# EasyEDA Pro project 智能车.eprj, schematic 主板V2.0

## Sheets
1 P1: Create Date: 2024-03-19; Page Name: P1; Project Name: 智能车; Schematic Name: Schematic4; Update Date: 2024-08-10; Company: 嘉立创EDA; Page Size: A4; Version: V1.0
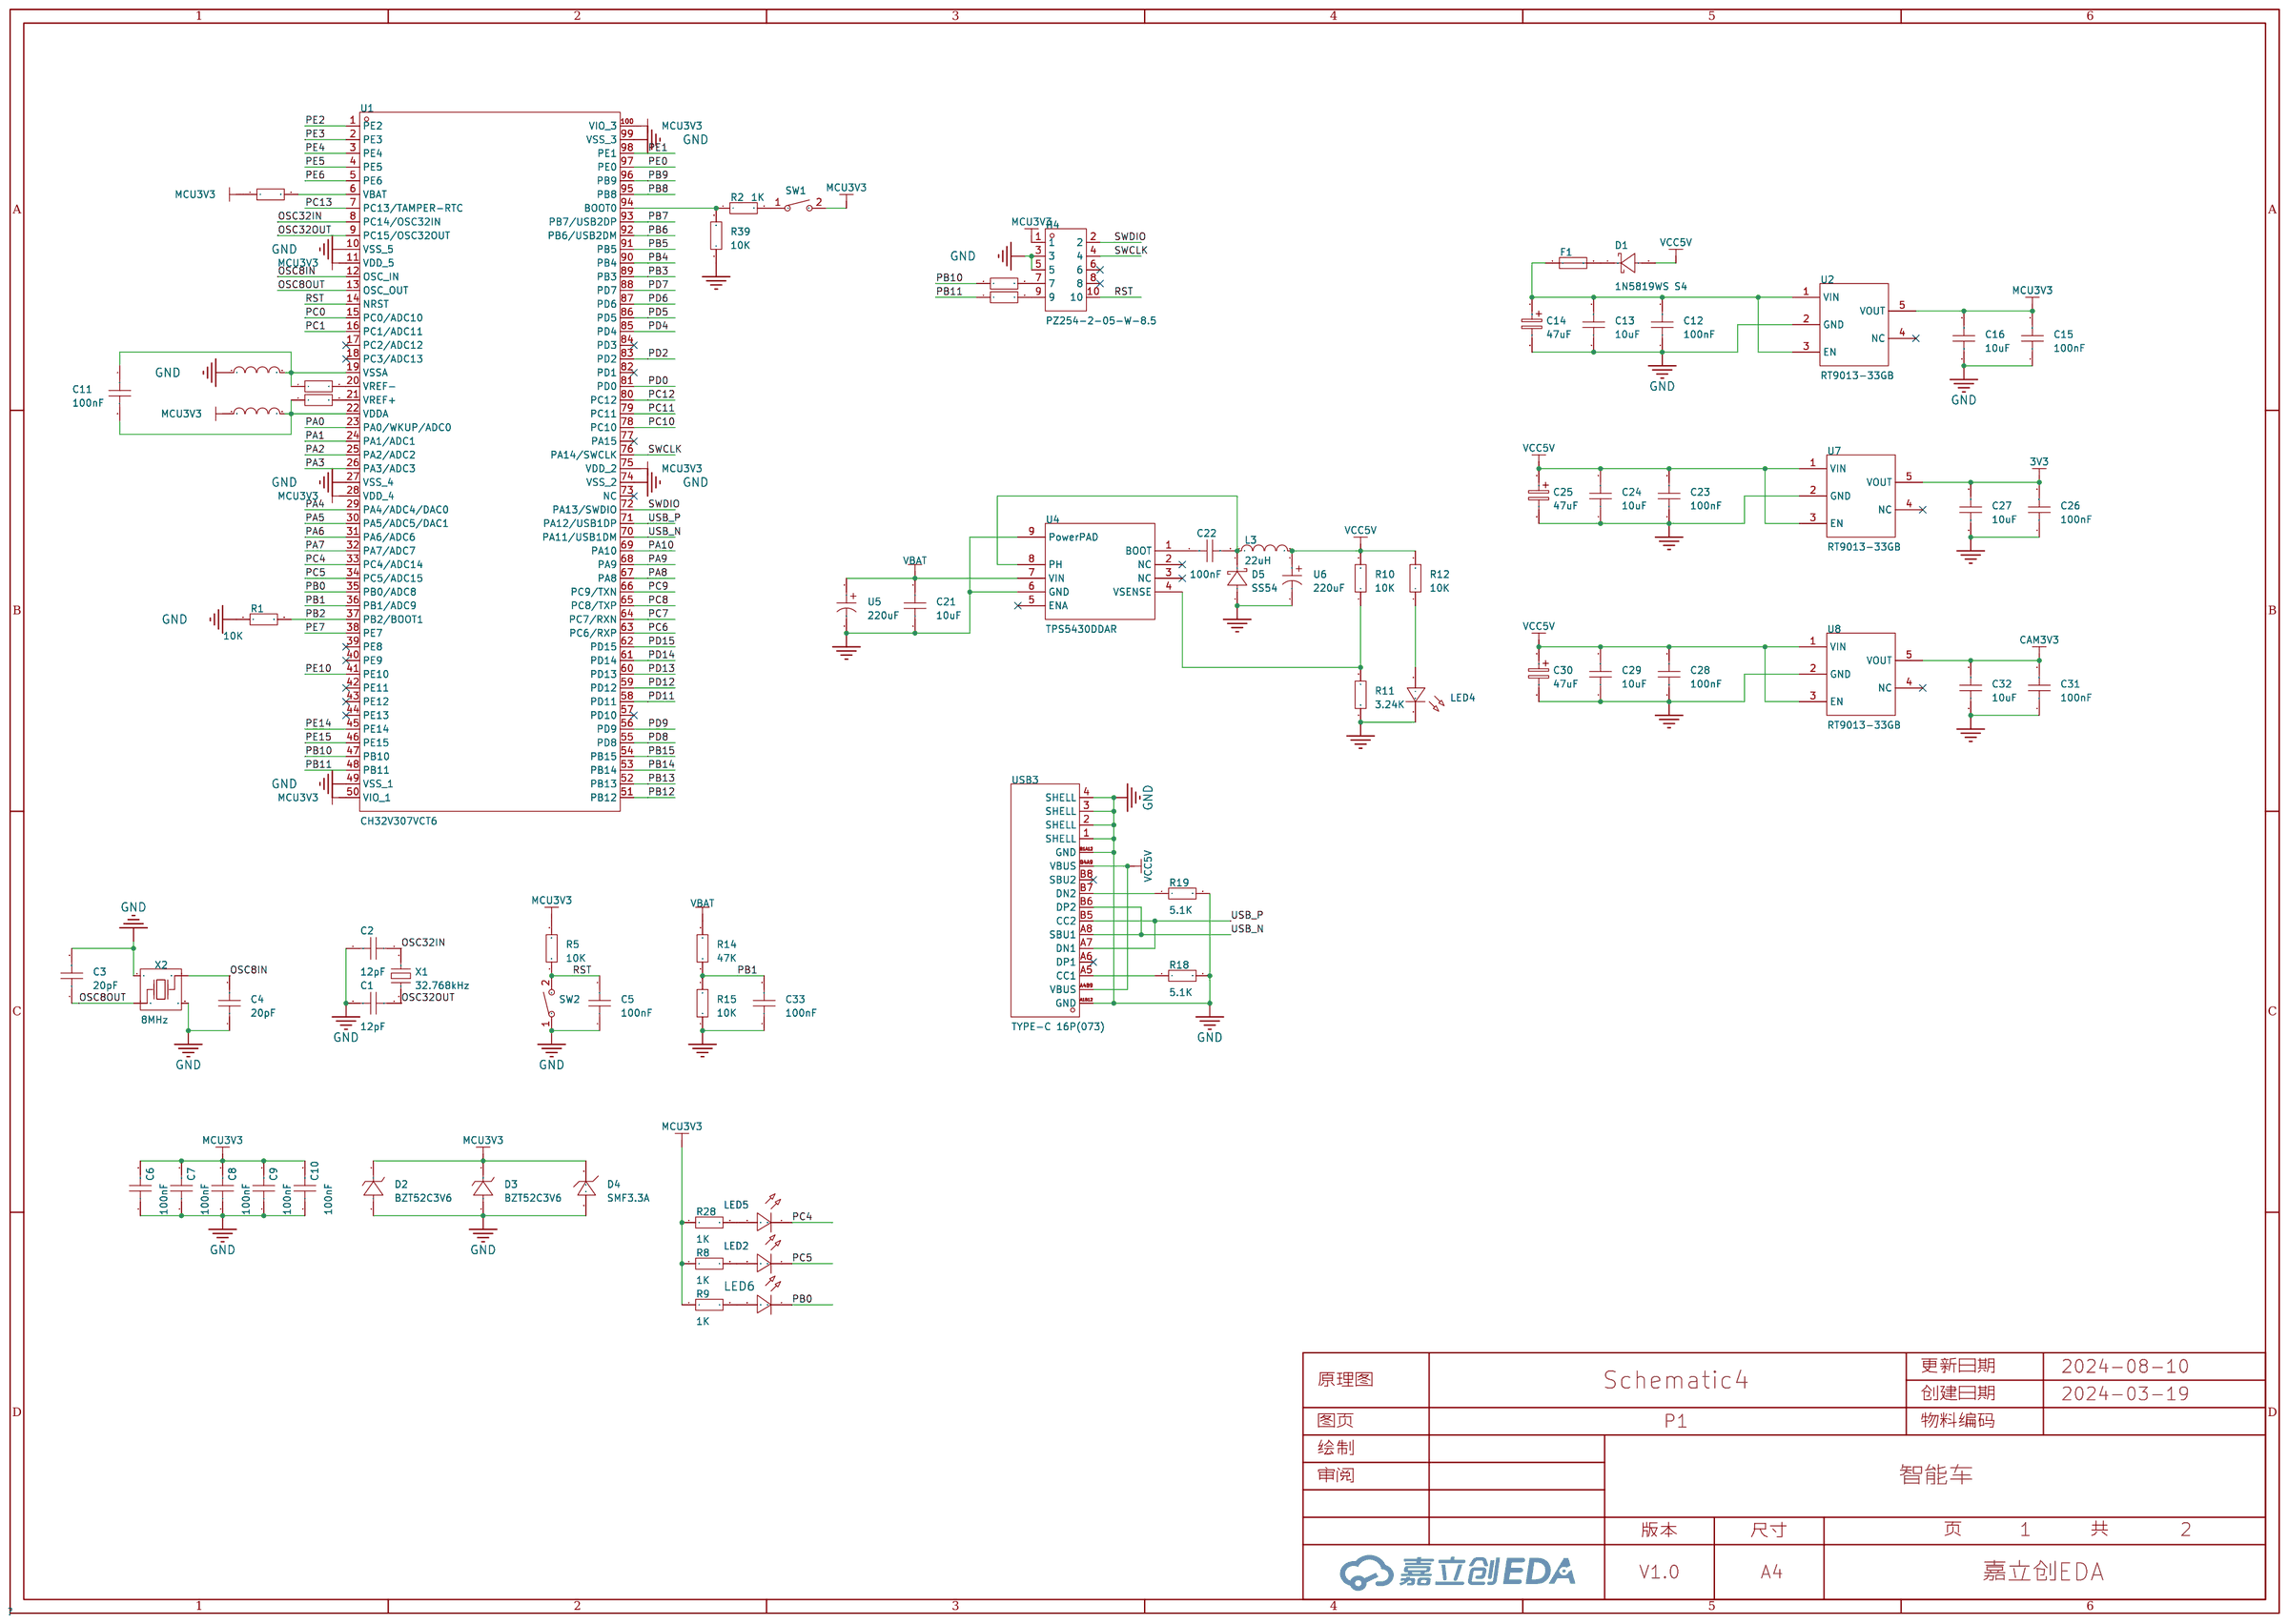
[diagram p8: P1]
2 P2: Page Name: P2; Update Date: 2024-03-29
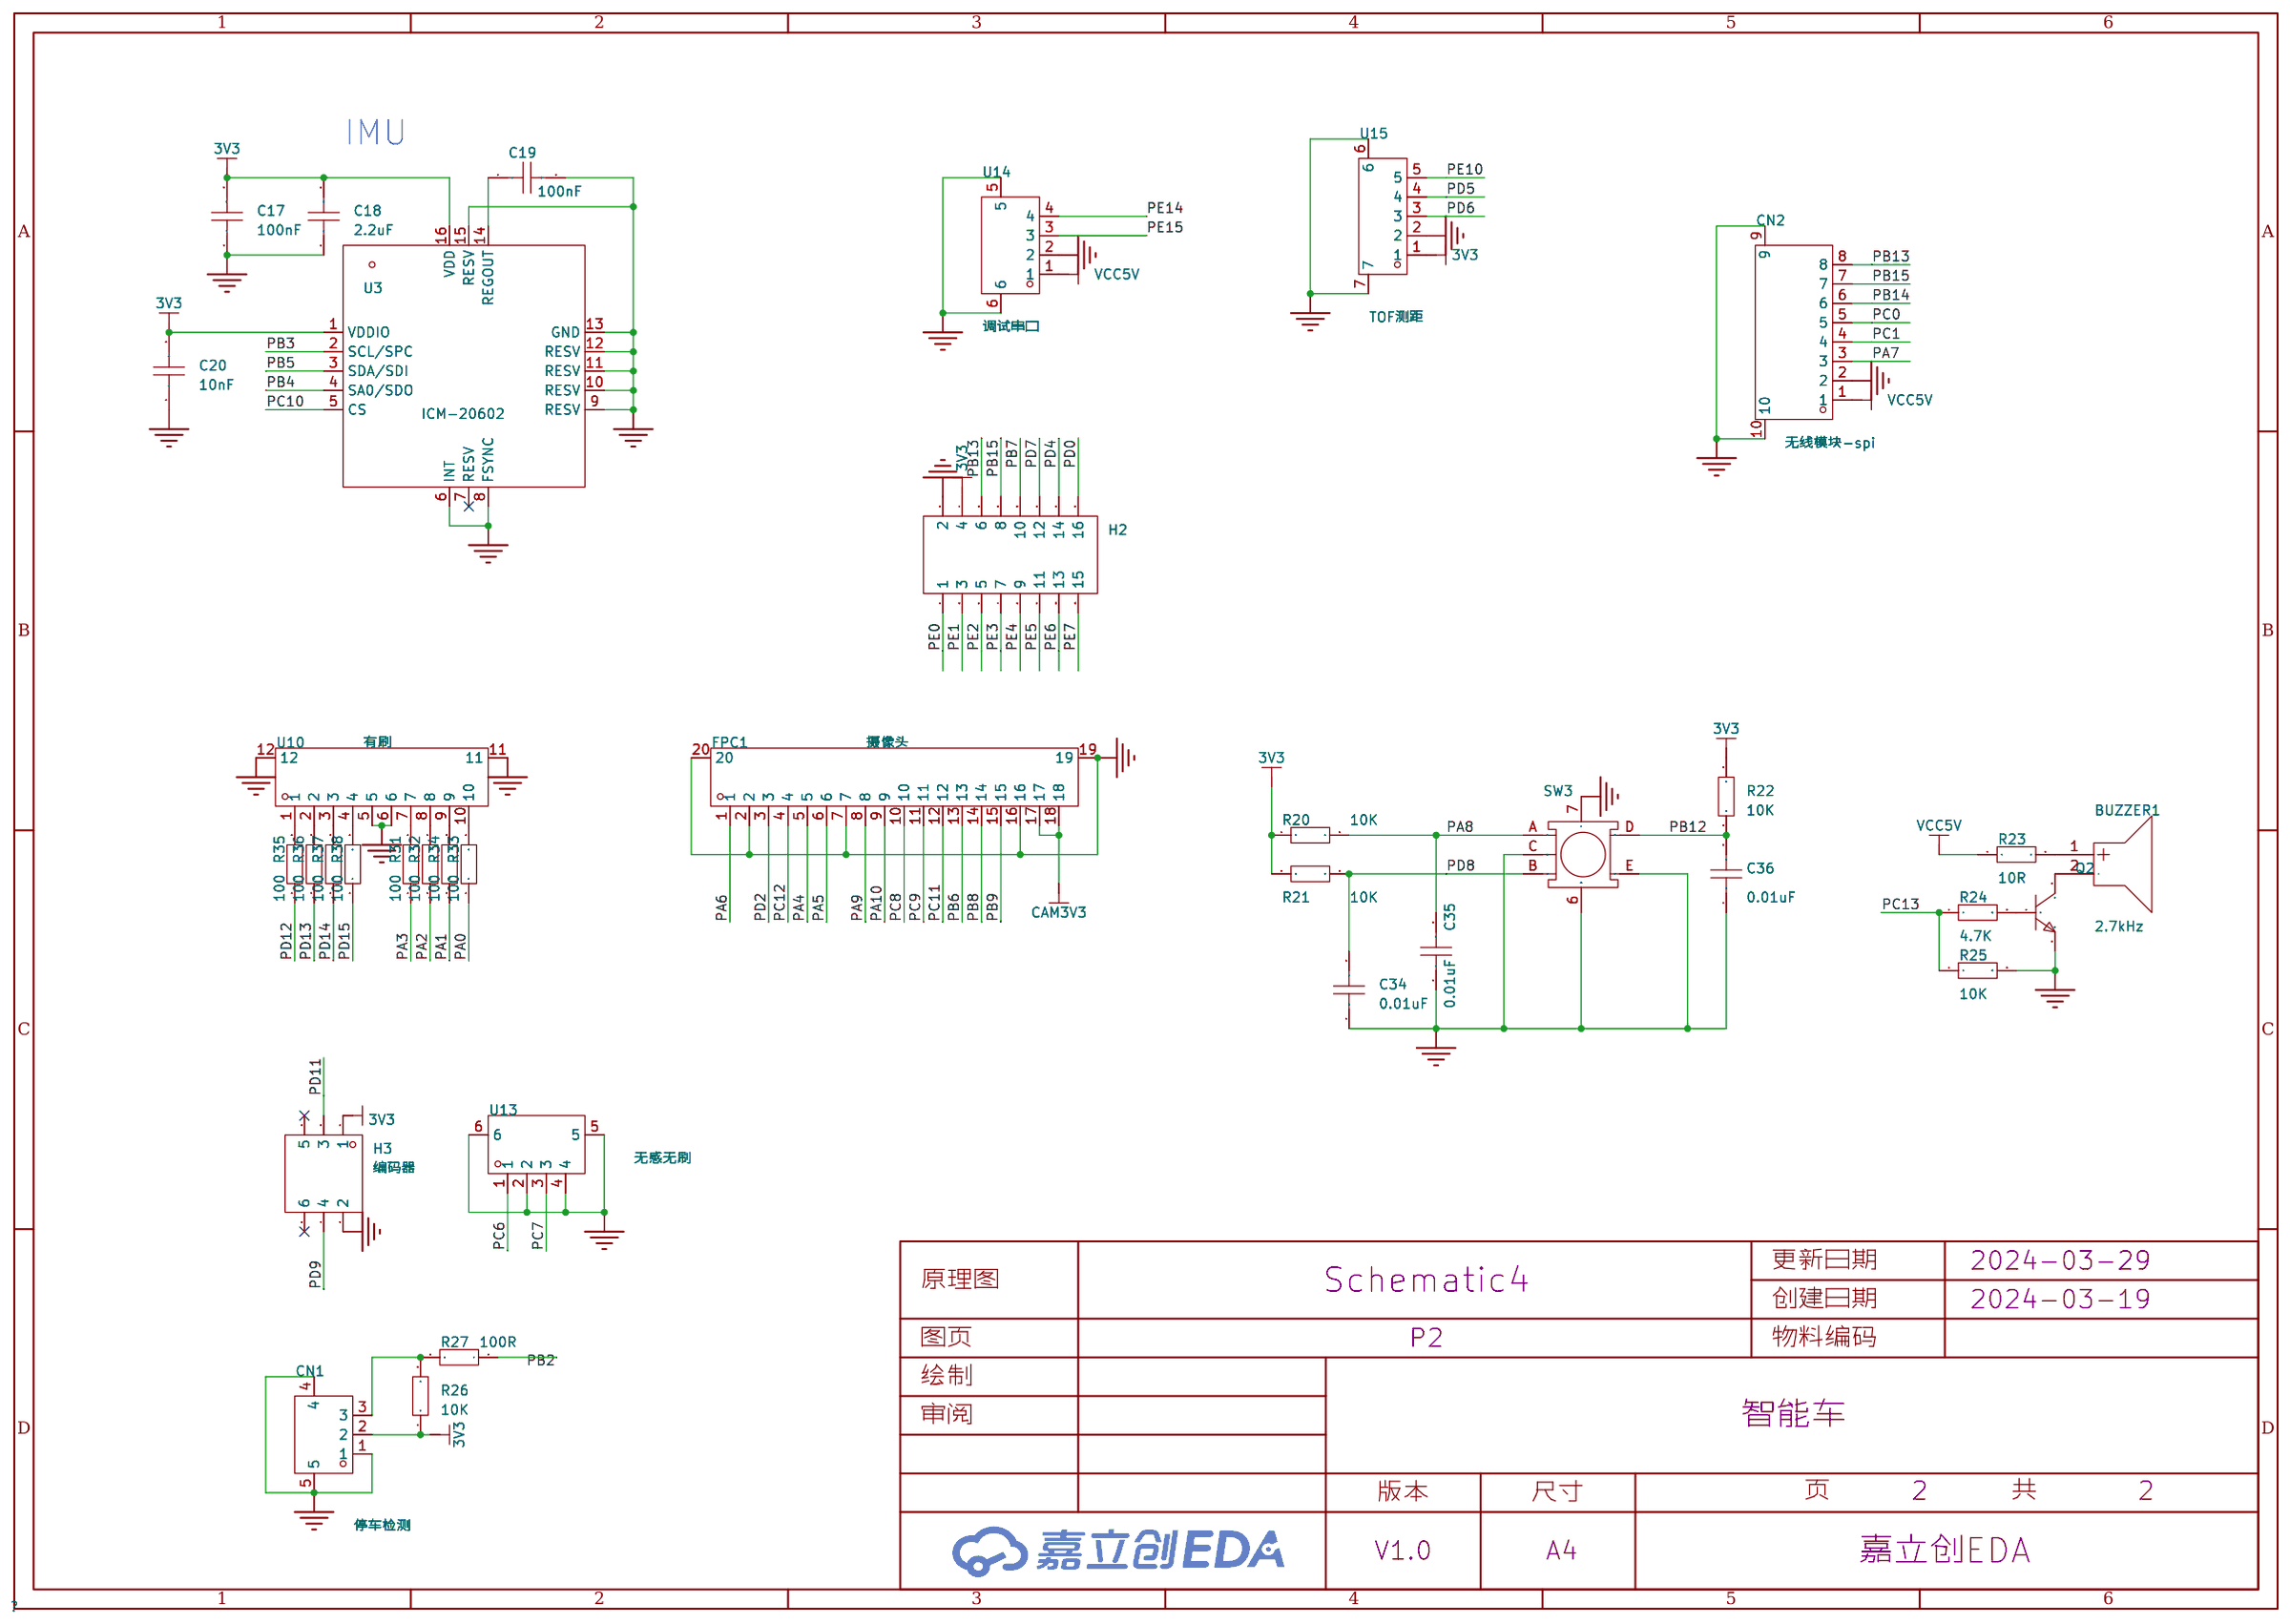
[diagram p9: P2]

## Parts
sheet P1
C1  12pF  [C0402]
C2  12pF  [C0402]
C3  20pF  [C0402]
C4  20pF  [C0402]
C5  100nF  [C0402]
C6  100nF  [C0402]
C7  100nF  [C0402]
C8  100nF  [C0402]
C9  100nF  [C0402]
C10  100nF  [C0402]
C11  100nF  [C0402]
C12  100nF  [C0402]
C13  10uF  [C0402]
C14  47uF  [CAP-SMD_L3.5-W2.8-R-RD]
C15  100nF  [C0402]
C16  10uF  [C0402]
C21  10uF  [C0402]
C22  100nF  [C0402]
C23  100nF  [C0402]
C24  10uF  [C0402]
C25  47uF  [CAP-SMD_L3.5-W2.8-R-RD]
C26  100nF  [C0402]
C27  10uF  [C0402]
C28  100nF  [C0402]
C29  10uF  [C0402]
C30  47uF  [CAP-SMD_L3.5-W2.8-R-RD]
C31  100nF  [C0402]
C32  10uF  [C0402]
C33  100nF  [C0402]
D1  1N5819WS S4  [SOD-323_L1.6-W1.3-LS2.7-RD]
D2  BZT52C3V6  [SOD-123_L2.7-W1.7-LS3.8-RD]
D3  BZT52C3V6  [SOD-123_L2.7-W1.7-LS3.8-RD]
D4  SMF3.3A  [SOD-123_L2.8-W1.8-LS3.7-RD]
D5  SS54  [SMA_L4.3-W2.6-LS5.0-FD]
F1  BSMD0805-050-24V  [F0805]
H4  PZ254-2-05-W-8.5  [HDR-TH_10P-P2.54-H-M-R2-C5-S2.54-N]
L1  CBG100505U000T  [L0402]
L2  CBG100505U000T  [L0402]
L3  22uH  [IND-SMD_L7.1-W6.6]
LED2  -  [LED_0402]
LED4  -  [LED_0402]
LED5  -  [LED_0402]
LED6  -  [LED_0402]
R1  10K  [R0402]
R2  1K  [R0402]
R3  0R  [R0402]
R4  0R  [R0402]
R5  10K  [R0402]
R6  0R  [R0402]
R8  1K  [R0402]
R9  1K  [R0402]
R10  10K  [R0402]
R11  3.24K  [R0402]
R12  10K  [R0402]
R14  47K  [R0402]
R15  10K  [R0402]
R18  5.1K  [R0402]
R19  5.1K  [R0402]
R28  1K  [R0402]
R29  0R  [R0402]
R30  0R  [R0402]
R39  10K  [R0402]
SW1  TS342A2P-WZ  [SW-SMD_L4.0-W2.9-LS5.0]
SW2  TS342A2P-WZ  [SW-SMD_L4.0-W2.9-LS5.0]
U1  CH32V307VCT6  [LQFP-100_L14.0-W14.0-P0.50-LS16.0-BL]
U2  RT9013-33GB  [SOT-23-5_L3.0-W1.7-P0.95-LS2.8-BL]
U4  TPS5430DDAR  [ESOP-8_L4.9-W3.9-P1.27-LS6.0-TL-EP]
U5  220uF  [CAP-SMD_BD6.3-L6.6-W6.6-LS7.2-FD]
U6  220uF  [CAP-SMD_BD6.3-L6.6-W6.6-LS7.2-FD]
U7  RT9013-33GB  [SOT-23-5_L3.0-W1.7-P0.95-LS2.8-BL]
U8  RT9013-33GB  [SOT-23-5_L3.0-W1.7-P0.95-LS2.8-BL]
USB3  TYPE-C 16P(073)  [USB-C-SMD_TYPE-C16PIN_C668624]
X1  32.768kHz  [OSC-SMD_L3.2-W1.5]
X2  8MHz  [OSC-SMD_4P-L3.2-W2.5-BL]
sheet P2
BUZZER1  2.7kHz  [BUZ-TH_BD9.0-P4.00-D0.6-FD]
C17  100nF  [C0402]
C18  2.2uF  [C0402]
C19  100nF  [C0402]
C20  10nF  [C0402]
C34  0.01uF  [C0402]
C35  0.01uF  [C0402]
C36  0.01uF  [C0402]
CN1  停车检测  [CONN-TH_3P-P1.25_GH1.25]
CN2  无线模块-spi  [CONN-SMD_A1257WR-S-8P]
FPC1  摄像头  [FPC-SMD_18P-P0.50_FPC-05F-18PH20]
H2  -  [HDR-TH_16P-P2.54-V-F-R2-C8-S2.54-1]
H3  编码器  [HDR-TH_6P-P2.54-H-R2-C3-S2.54-W10.0_A2541WR]
Q2  -  [S8050_SOT-23]
R20  10K  [R0402]
R21  10K  [R0402]
R22  10K  [R0402]
R23  10R  [R0402]
R24  4.7K  [R0402]
R25  10K  [R0402]
R26  10K  [R0402]
R27  100R  [R0402]
R31  100  [R0402]
R32  100  [R0402]
R33  100  [R0402]
R34  100  [R0402]
R35  100  [R0402]
R36  100  [R0402]
R37  100  [R0402]
R38  100  [R0402]
SW3  EC11E18244A5  [SW-TH_EC11E18244A5]
U3  ICM-20602  [LGA-16_L3.0-W3.0-P0.50-BL]
U10  有刷  [CONN-SMD_10P-P1.25_XUNPU_WAFER-GH1.25-10PWB]
U13  无感无刷  [CONN-SMD_4P-P1.25_XUNPU_WAFER-GH1.25-4PWB]
U14  调试串口  [CONN-SMD_4P-P1.25_XUNPU_WAFER-GH1.25-4PWB]
U15  TOF测距  [CONN-SMD_5P-P1.25_XUNPU_WAFER-GH1.25-5PWB]

## Library data of the parts
C1-C13 C15 C16 C21-C24 C26-C29 C31-C33 = CAP_0402: Supplier Footprint: 0402
C14 C25 C30 = CA45-B-16V-47uF-K: 容值:47uF;精度:±10%;额定电压:16V;等效串联电阻:3Ω@100kHz;; LCSC Part Name: 47uF ±10% 16V; Supplier Part: C136751; Manufacturer: CEC(振华新云); Supplier Footprint: CASE-B-3528; JLCPCB Part Class: Extended Part; Datasheet: https://atta.szlcsc.com/upload/public/pdf/source/20200817/C136751_89CB14FC7BB434027D9410E248BC6FA3.pdf; Supplier: LCSC; Tolerance: ±10%; Rated Voltage: 16V; Equivalent Series Resistance(ESR): 3Ω@100kHz; Operating Temperature: -55℃~+125℃
D1 = 1N5819WS S4_C2927280: 二极管配置:独立式;正向压降(Vf):600mV@200mA;直流反向耐压(Vr):40V;平均整流电流(Io):350mA;; LCSC Part Name: 电压:40V 电流:350mA; Supplier Part: C2927280; Manufacturer: JSMSEMI(杰盛微); Supplier Footprint: SOD-323; JLCPCB Part Class: Extended Part; Datasheet: https://atta.szlcsc.com/upload/public/pdf/source/20240105/574E572B69D2DF1CD36E5C05FAB269C4.pdf; Supplier: LCSC; Diode Configuration: 独立式; Forward Voltage (Vf@If): 600mV@200mA; Reverse Voltage (Vr): 40V; Average Rectified Current (Io): 350mA; Reverse Leakage Current (Ir): 5uA@30V
D2 D3 = BZT52C3V6_C726991: 稳压值(标称值):3.6V;功率:500mW;精度:-;; Supplier Part: C726991; Manufacturer: TWGMC(台湾迪嘉); Supplier Footprint: SOD-123; JLCPCB Part Class: Extended Part; Datasheet: https://atta.szlcsc.com/upload/public/pdf/source/20200825/C726987_AA6CB64B7861C942BF0EE5963BB1FA70.pdf; Supplier: LCSC; Zener Voltage (Nom): 3.6V; Reverse Leakage Current (Ir): 5uA@1V; Power Dissipation: 500mW
D4 = SMF3.3A_C283866: 反向截止电压(Vrwm):3.3V;最大钳位电压:8V;峰值脉冲电流(Ipp)@10/1000us:25A;击穿电压:5.2V;; Supplier Part: C283866; Manufacturer: DOWO(东沃); Supplier Footprint: SOD-123; JLCPCB Part Class: Extended Part; Datasheet: https://atta.szlcsc.com/upload/public/pdf/source/20180913/C283866_6B3FC7DB82D40F63EC323F6A8CE1774A.pdf; Supplier: LCSC; Reverse Stand-Off Voltage (Vrwm): 3.3V; Maximum Clamping Voltage: 8V; Peak Pulse Current (Ipp)@10/1000us: 25A; Breakdown Voltage: 5.2V; Reverse Leakage Current (Ir): 600uA; Type: TVS
D5 = SS54_C7420369: 二极管配置:独立式;正向压降(Vf):550mV@5.0A;直流反向耐压(Vr):40V;平均整流电流(Io):5A;; LCSC Part Name: 电压:40V 电流:5A; Supplier Part: C7420369; Manufacturer: 宏迦橙; Supplier Footprint: SMA(DO-214AC); JLCPCB Part Class: Extended Part; Datasheet: https://atta.szlcsc.com/upload/public/pdf/source/20230828/254C3882F8647358AD9F60DD73611B5E.pdf; Supplier: LCSC; Diode Configuration: 独立式; Forward Voltage (Vf@If): 550mV@5.0A; Reverse Voltage (Vr): 40V; Average Rectified Current (Io): 5A; Reverse Leakage Current (Ir): 50uA@40V; Peak forward surge current: 120A
F1 = BSMD0805-050-24V: 最大电压:24V;最大电流:40A;保持电流:500mA;跳闸电流:1A;; LCSC Part Name: 24V 500mA 0805自恢复; Supplier Part: C910822; Manufacturer: BHFUSE(佰宏); Supplier Footprint: 0805; JLCPCB Part Class: 扩展库; Datasheet: https://atta.szlcsc.com/upload/public/pdf/source/20240115/B58FC9AAFFD82092B1474BA131F9837E.pdf; Supplier: LCSC; Operating Voltage (Max): 24V; Current Rating (Max): 40A; Hold Current: 500mA; Trip Current: 1A; Power Dissipation: 600mW; Resistance - Initial (Ri) (Min): 100mΩ; Resistance - Post Trip (R1) (Max): 850mΩ; Maximum Time to Trip: 100ms; Operating Temperature: -40℃~+85℃
H4 = PZ254-2-05-W-8.5: 插针结构:2x5P;间距:2.54mm;行距:2.54mm;圆针/方针:方针;安装类型:弯插;排数:双排;总PIN位数:10P;额定电流:3A;额定电压:-;配合针长度:6mm;塑高:2.5mm;端接针长度:-;触头材质:-;工作温度范围:-40℃~+105℃;焊接温度(最大值):260℃@10S;颜色:黑色;; LCSC Part Name: 2x5P 间距:2.54mm 方针 弯插; Supplier Part: C2894985; Manufacturer: HCTL(华灿天禄); Supplier Footprint: 弯插,P=2.54mm; JLCPCB Part Class: Extended Part; Datasheet: https://atta.szlcsc.com/upload/public/pdf/source/20230609/1B60364E488FD8696AA7206A46578DEA.pdf; Supplier: LCSC; Pin Structure: 2x5P; Pitch: 2.54mm; Row Spacing: 2.54mm; Circluar Pins/Square Pins: 方针; Mounting Type: 弯插; Number of Rows: 双排; Number of Pins: 10P; Current Rating (Max): 3A; Length of Mating Pin: 6mm; Insulation Height: 2.5mm; Operating Temperature Range: -40℃~+105℃; Soldering Temperature(Max): 260℃@10S; Color: 黑色
L1 L2 = CBG100505U000T: 标称阻抗@测试频率:0Ω@100MHz;直流电阻(RDC):100mΩ;; LCSC Part Name: 单路 0402磁珠 阻抗0Ω@100MHz; Supplier Part: C139137; Manufacturer: FH(风华); Supplier Footprint: 0402; JLCPCB Part Class: Extended Part; Datasheet: https://atta.szlcsc.com/upload/public/pdf/source/20180917/C294510_876BBCD5BD7C9EF2E8468360D8BC49D0.pdf; Supplier: LCSC; Impedance @ Frequency: 0Ω@100MHz; DC Resistance: 100mΩ; Current Rating: 300mA; Circuits: 1
L3 = YSPI0630A-220M: 电感值:22uH;精度:±20%;额定电流:3A;; LCSC Part Name: 22uH ±20%; Supplier Part: C497873; Manufacturer: YJYCOIN(益嘉源); Supplier Footprint: SMD,6.6x7.1mm; JLCPCB Part Class: 扩展库; Datasheet: https://atta.szlcsc.com/upload/public/pdf/source/20200317/C497869_D09F597887D5FB8B541C5C98B400E286.pdf; Supplier: LCSC; Tolerance: ±20%; Rated Current: 3A; DC Resistance (DCR): 130mΩ
LED2 = LED_0402-B: Supplier Footprint: 0402
LED4 LED5 = LED_0402-G: Supplier Footprint: 0402
LED6 = LED_0402-R: Supplier Footprint: 0402
R1-R6 R8-R12 R14 R15 R18-R22 R28-R39 = Res_0402: Supplier Footprint: 0402
SW1 SW2 = TS342A2P-WZ: 电路结构:单刀单掷;按钮形状:圆形按钮;安装方式:立贴;开关长度:3.95mm;开关宽度:2.9mm;开关高度:2mm;带支架:不带;触点电流:50mA;额定电压(DC):12V;绝缘电阻:100MΩ;机械寿命:3万次;; LCSC Part Name: 3.95*2.9*2mm 立贴 轻触开关; Supplier Part: C557591; Manufacturer: SHOU HAN(首韩); Supplier Footprint: SMD; JLCPCB Part Class: 扩展库; Datasheet: https://atta.szlcsc.com/upload/public/pdf/source/20200519/C557591_B3A5A21584733303F06306F18577DA8B.pdf; Supplier: LCSC; Circuit: 单刀单掷; Actuator Style: 圆形按钮; Mounting Style: 立贴; Switch Length: 3.95mm; Switch Width: 2.9mm; Switch Height: 2mm; Strike Gundam: 不带; Contact Current: 50mA; Voltage Rating (DC): 12V; Insulation Resistance: 100MΩ; Actuator/Cap Color: 黑色; Pin Style: SMD接片; Mechanical Life: 3万次; Operating Temperature: -25℃~+70℃
U1 = CH32V307VCT6: CPU内核:RISC-V;程序存储容量:256KB;RAM总容量:64KB;GPIO端口数量:80;工作电压范围:2.5V~3.3V;CPU最大主频:144MHz;程序存储器类型:FLASH;应用领域:-;; Supplier Part: C2943979; Manufacturer: WCH(南京沁恒); Supplier Footprint: LQFP-100(14x14); JLCPCB Part Class: 扩展库; Datasheet: https://atta.szlcsc.com/upload/public/pdf/source/20220111/249074F152243A2E6E0364BFD3BF5289.pdf; Supplier: LCSC; CPU Core: RISC-V; Program Storage Size: 256KB; RAM Size: 64KB; GPIO Ports Number: 80; Operating Voltage Range: 2.5V~3.3V; CPU Maximum Speed: 144MHz; Program Memory Type: FLASH; Operating Temperature Range: -40℃~+85℃; ADC (Bit): 12bit; DAC (Bit): 12bit; PWM (Bit): 16bit; 16Bit Timer: 10; CAN: 2; UART/USART: 8; I2C: 2; I2S: 2; SPI: 3; Universal Serial Bus: 有; Internal Comparator: 有; Watchdog: 有; Real-Time Clock: 有; Infrared Data Association: 有; Low-Voltage Detect: 有; CCP Capture/Compare: 有; LCD Module: 有; Secure Digital Input and Output: 有; Direct Memory Access: 有; Internal Oscillator: 有
U2 U7 U8 = RT9013-33GB: 输出类型:固定;最大输入电压:5.5V;输出电压:3.3V;最大输出电流:500mA;电源纹波抑制比(PSRR):50dB@(10kHz);输出极性:正极;; LCSC Part Name: 输入5.5V 输出3.3V 500mA; Supplier Part: C47773; Manufacturer: RICHTEK(立锜); Supplier Footprint: SOT-23-5; JLCPCB Part Class: 扩展库; Datasheet: https://atta.szlcsc.com/upload/public/pdf/source/20150504/1457707282459.pdf; Supplier: LCSC; Output Type: 固定; Maximum Input Voltage: 5.5V; Output Voltage: 3.3V; MAX Output Current: 500mA; Power Supply Rejection Ratio (PSRR): 50dB@(10kHz); Dropout Voltage: 400mV@(500mA); standby current: 50uA; Operating Temperature: -40℃~+85℃; Output Polarity: 正极; Number of Outputs: 1
U4 = TPS5430DDAR: 功能类型:降压型;输出类型:可调;输入电压:5.5V~36V;输出电压:1.221V~32.04V;输出电流(最大值):3A;; LCSC Part Name: 降压 3A 36V; Supplier Part: C9864; Manufacturer: TI(德州仪器); Supplier Footprint: SOIC-8-EP; JLCPCB Part Class: Basic Part; Datasheet: https://www.ti.com/cn/lit/gpn/tps5430; Supplier: LCSC; Function: 降压型; Output Type: 可调; Input Voltage: 5.5V~36V; Output Voltage: 1.221V~32.04V; Output Current (Max): 3A; Switching Frequency: 500kHz; Operating Temperature: -40℃~+125℃@(TJ); Synchronous Rectification: 否; Number of Outputs: 1; Topology: 降压式; Switch tube (built-in/external): 内置
U5 U6 = RST220UF25V019: 容值:220uF;精度:±20%;额定电压:25V;纹波电流:165mA@120Hz;等效串联电阻:-;; LCSC Part Name: 220uF ±20% 25V; Supplier Part: C4747974; Manufacturer: KNSCHA(科尼盛); Supplier Footprint: SMD,D6.3xL7.7mm; JLCPCB Part Class: Extended Part; Datasheet: https://atta.szlcsc.com/upload/public/pdf/source/20220722/2E7F51AC9BE193B364DA1207D7353D66.pdf; Supplier: LCSC; Tolerance: ±20%; Rated Voltage: 25V; Ripple Current: 165mA@120Hz; φD: 6.3mm; L: 7.7mm; Lifetime @ Temp: 2000hrs@105℃; Operating Temperature: -40℃~+105℃
USB3 = TYPE-C 16P(073): 连接器类型:Type-C;标准:-;公母:母;端口数量:1;触点数量:16P;安装方式:卧贴;额定电流 - 电源:5A;工作温度范围:-25℃~+85℃;; LCSC Part Name: Type-C 母 卧贴; Supplier Part: C668624; Manufacturer: SHOU HAN(首韩); Supplier Footprint: SMD; JLCPCB Part Class: Extended Part; Datasheet: https://atta.szlcsc.com/upload/public/pdf/source/20200618/C668624_CC51EC37614090AAD56C1421DE954C80.pdf; Supplier: LCSC; Connector Type: Type-C; Gender: 母; Number of Ports: 1; Number of Contacts: 16P; Mounting Style: 卧贴; Current Rating - Power (Max): 5A; Operating Temperature Range: -25℃~+85℃
X1 = X321532768KGD2SI: 晶振类型:贴片晶振;频率:32.768kHz;常温频差:±20ppm;外接负载电容:12.5pF;; LCSC Part Name: 32.768kHz ±20ppm 12.5pF; Supplier Part: C620155; Manufacturer: YXC(扬兴晶振); Supplier Footprint: SMD3215-2P; JLCPCB Part Class: 扩展库; Datasheet: https://atta.szlcsc.com/upload/public/pdf/source/20210329/C620155_E5A74FC0D27C5E9015A8D75DE9484FEA.pdf; Supplier: LCSC; Crystal Type: 贴片晶振; Normal temperature Frequency Tolerance: ±20ppm; External load capacitor: 12.5pF; Operating Temperature: -40℃~+85℃
X2 = TAXM8M4RDBCCT2T: 晶振类型:贴片晶振;频率:8MHz;常温频差:±10ppm;外接负载电容:10pF;频率稳定度(全温):±15ppm;; LCSC Part Name: 8MHz ±10ppm 10pF; Supplier Part: C400090; Manufacturer: YJX(雅晶鑫); Supplier Footprint: SMD3225-4P; JLCPCB Part Class: 扩展库; Datasheet: https://atta.szlcsc.com/upload/public/pdf/source/20190626/C400090_CF95B89E745AFE4EF2E392EF8AC009D6.pdf; Supplier: LCSC; Crystal Type: 贴片晶振; Normal temperature Frequency Tolerance: ±10ppm; External load capacitor: 10pF; Frequency Stability(Full temperature range): ±15ppm; Equivalent Series Resistance (ESR): 250Ω; Operating Temperature: -40℃~+85℃
BUZZER1 = YS-MBZ9042C05R42: 驱动方式:无源(外部驱动);构造类型:电磁式;频率:2.7kHz;声压(SPL):85dB@5V,10cm;; LCSC Part Name: 电磁式无源蜂鸣器5V; Supplier Part: C409837; Manufacturer: Fengming(锋鸣电子); Supplier Footprint: 插件,D=9mm; JLCPCB Part Class: 扩展库; Datasheet: https://atta.szlcsc.com/upload/public/pdf/source/20191217/C409837_893ADB678ED7E25111BC2D1A287FE6B1.pdf; Supplier: LCSC; Oscillator Circuit: 无源(外部驱动); Technology Type: 电磁式; Operating Voltage: 3V~7V; Sound Pressure Level (SPL): 85dB@5V,10cm; Diameter (φD): 9mm; Height: 4.4mm
C17-C20 C34-C36 = CAP_0603: Supplier Footprint: 0603
CN1 = WAFER-GH1.25-3PWB: 插针结构:1x3P;间距:1.25mm;安装方式:卧贴;参考系列:GH;总PIN数:3P;排数:1;每排PIN数:3;额定电流:1A;工作温度范围:-25℃~+85℃;; LCSC Part Name: 1x3P 间距:1.25mm 卧贴 系列:GH; Supplier Part: C3029378; Manufacturer: XUNPU(讯普); Supplier Footprint: SMD,P=1.25mm,卧贴; JLCPCB Part Class: Extended Part; Datasheet: https://atta.szlcsc.com/upload/public/pdf/source/20220527/CB8773BFB0913C3B8ABD62CB38BA101A.pdf; Supplier: LCSC; Pins Structure: 1x3P; Pitch: 1.25mm; Mounting Style: 卧贴; Reference Series: GH; Number of Pins: 3P; Number of Rows: 1; Number of PINs Per Row: 3; Current Rating (Max): 1A; Operating Temperature Range: -25℃~+85℃
CN2 = A1257WR-S-8P: 插针结构:1x8P;间距:1.25mm;安装方式:-;参考系列:GH;总PIN数:8P;排数:1;每排PIN数:8;行距:-;触头材质:黄铜;; LCSC Part Name: 系列:GH 间距:1.25mm 1x8P; Supplier Part: C225131; Manufacturer: CJT(长江连接器); Supplier Footprint: SMD,P=1.25mm; JLCPCB Part Class: Extended Part; Datasheet: https://atta.szlcsc.com/upload/public/pdf/source/20181008/C272994_C9E89FA8A36D0009CAD30AD8C59C2782.pdf; Supplier: LCSC; Pins Structure: 1x8P; Pitch: 1.25mm; Reference Series: GH; Number of Pins: 8P; Number of Rows: 1; Number of PINs Per Row: 8; Contact Material: 黄铜
FPC1 = FPC-05F-18PH20: 间距:0.5mm;触点数量:18P;锁定特性:翻盖式;触点类型:下接;安装类型:卧贴;工作温度范围:-25℃~+85℃;; LCSC Part Name: 间距:0.5mm P数:18P 翻盖式 下接; Supplier Part: C2856802; Manufacturer: XUNPU(讯普); Supplier Footprint: SMD,P=0.5mm,卧贴; JLCPCB Part Class: 扩展库; Datasheet: https://atta.szlcsc.com/upload/public/pdf/source/20210922/C2856802_2A845D1961F33AEC1ED22CECB292335F.pdf; Supplier: LCSC; Pitch: 0.5mm; Number of Contacts: 18P; Locking Feature: 翻盖式; FFC, FCB Thickness: 0.3mm; Contact Type: 下接; Mounting Type: 卧贴; Height Above Board: 2mm; Operating Temperature Range: -25℃~+85℃
H2 = HDR-F_2.54_2x8: Supplier Part: C30734; Supplier Footprint: 插件
H3 = A2541WR-2x3P: 插针结构:2x3P;间距:2.54mm;行距:2.54mm;圆针/方针:方针;安装类型:弯插;排数:双排;总PIN位数:6P;额定电流:-;额定电压:-;配合针长度:6mm;塑高:2.54mm;触头材质:黄铜;触头镀层:-;工作温度范围:-40℃~+105℃;颜色:黑色;; LCSC Part Name: 间距:2.54mm 2x3P 弯插 方针; Supplier Part: C239334; Manufacturer: CJT(长江连接器); Supplier Footprint: 弯插,P=2.54mm; JLCPCB Part Class: Extended Part; Datasheet: https://atta.szlcsc.com/upload/public/pdf/source/20180724/C239359_48B1BC0CA1B4E4396A63955AAFD15564.pdf; Supplier: LCSC; Pin Structure: 2x3P; Pitch: 2.54mm; Row Spacing: 2.54mm; Circluar Pins/Square Pins: 方针; Mounting Type: 弯插; Number of Rows: 双排; Number of Pins: 6P; Length of Mating Pin: 6mm; Insulation Height: 2.54mm; Contact Material: 黄铜; Operating Temperature Range: -40℃~+105℃; Color: 黑色
Q2 = S8050_SOT_NPN: Supplier Footprint: SOT-23
R23-R27 = Res_0603: Supplier Footprint: 0603
SW3 = EC11E18244A5: Supplier Part: C255515; Manufacturer: ALPSALPINE(阿尔卑斯阿尔派); Supplier Footprint: 插件; JLCPCB Part Class: Extended Part; Datasheet: https://atta.szlcsc.com/upload/public/pdf/source/20180717/C255515_FDB072715C920DA9BADE9D32EFEB8093.pdf; Supplier: LCSC
U3 = ICM-20602: Supplier Part: C97633; Manufacturer: TDK InvenSense(应美盛); Supplier Footprint: LGA-16(3x3); JLCPCB Part Class: 扩展库; Datasheet: https://atta.szlcsc.com/upload/public/pdf/source/20211201/22F52CD68708988CA74F73A6E0913E27.pdf; Supplier: LCSC
U10 = WAFER-GH1.25-10PWB: 插针结构:1x10P;间距:1.25mm;安装方式:卧贴;参考系列:GH;总PIN数:10P;排数:1;每排PIN数:10;额定电流:1A;工作温度范围:-25℃~+85℃;; LCSC Part Name: 1x10P 间距:1.25mm 卧贴 系列:GH; Supplier Part: C3029385; Manufacturer: XUNPU(讯普); Supplier Footprint: SMD,P=1.25mm,卧贴; JLCPCB Part Class: Extended Part; Datasheet: https://atta.szlcsc.com/upload/public/pdf/source/20220527/CB8773BFB0913C3B8ABD62CB38BA101A.pdf; Supplier: LCSC; Pins Structure: 1x10P; Pitch: 1.25mm; Mounting Style: 卧贴; Reference Series: GH; Number of Pins: 10P; Number of Rows: 1; Number of PINs Per Row: 10; Current Rating (Max): 1A; Operating Temperature Range: -25℃~+85℃
U13 U14 = WAFER-GH1.25-4PWB: 插针结构:1x4P;间距:1.25mm;安装方式:卧贴;参考系列:GH;总PIN数:4P;排数:1;每排PIN数:4;额定电流:1A;工作温度范围:-25℃~+85℃;; LCSC Part Name: 1x4P 间距:1.25mm 卧贴 系列:GH; Supplier Part: C3029379; Manufacturer: XUNPU(讯普); Supplier Footprint: SMD,P=1.25mm,卧贴; JLCPCB Part Class: 扩展库; Datasheet: https://atta.szlcsc.com/upload/public/pdf/source/20220527/CB8773BFB0913C3B8ABD62CB38BA101A.pdf; Supplier: LCSC; Pins Structure: 1x4P; Pitch: 1.25mm; Mounting Style: 卧贴; Reference Series: GH; Number of Pins: 4P; Number of Rows: 1; Number of PINs Per Row: 4; Current Rating (Max): 1A; Operating Temperature Range: -25℃~+85℃
U15 = WAFER-GH1.25-5PWB: 插针结构:1x5P;间距:1.25mm;安装方式:卧贴;参考系列:GH;总PIN数:5P;排数:1;每排PIN数:5;额定电流:1A;工作温度范围:-25℃~+85℃;; LCSC Part Name: 1x5P 间距:1.25mm 卧贴 系列:GH; Supplier Part: C3029380; Manufacturer: XUNPU(讯普); Supplier Footprint: SMD,P=1.25mm,卧贴; JLCPCB Part Class: Extended Part; Datasheet: https://atta.szlcsc.com/upload/public/pdf/source/20220527/CB8773BFB0913C3B8ABD62CB38BA101A.pdf; Supplier: LCSC; Pins Structure: 1x5P; Pitch: 1.25mm; Mounting Style: 卧贴; Reference Series: GH; Number of Pins: 5P; Number of Rows: 1; Number of PINs Per Row: 5; Current Rating (Max): 1A; Operating Temperature Range: -25℃~+85℃

## Nets
3V3: C17.2 C18.2 C20.2 C26.2 C27.2 CN1.2 H2.4 H3.1 R20.1 R21.1 R22.2 R26.1 U3.1(VDDIO) U3.16(VDD) U7.5(VOUT) U15.1
GND: C1.1 C2.1 C3.2 C4.1 C5.1 C6.1 C7.1 C8.1 C9.1 C10.1 C12.1 C13.1 C14.2 C15.1 C16.1 C17.1 C18.1 C19.2 C20.1 C21.1 C23.1 C24.1 C25.2 C26.1 C27.1 C28.1 C29.1 C30.2 C31.1 C32.1 C33.1 C34.1 C35.1 C36.1 CN1.1 CN1.4 CN1.5 CN2.2 CN2.9 CN2.10 D2.2(A) D3.2(A) D4.2 D5.1(A) FPC1.2 FPC1.7 FPC1.16 FPC1.19 FPC1.20 H2.2 H3.2 H4.3 H4.5 L1.1 LED4.1(C) Q2.2 R1.1 R11.1 R15.1 R18.2 R19.2 R25.2 R39.1 SW2.1 SW3.6 SW3.7 SW3.C SW3.E U1.10(VSS_5) U1.27(VSS_4) U1.49(VSS_1) U1.74(VSS_2) U1.99(VSS_3) U2.2(GND) U3.6(INT) U3.8(FSYNC) U3.9(RESV) U3.10(RESV) U3.11(RESV) U3.12(RESV) U3.13(GND) U3.15(RESV) U4.6(GND) U4.9(PowerPAD) U5.2 U6.2 U7.2(GND) U8.2(GND) U10.5 U10.6 U10.11 U10.12 U13.2 U13.4 U13.5 U13.6 U14.2 U14.5 U14.6 U15.2 U15.6 U15.7 USB3.1(SHELL) USB3.2(SHELL) USB3.3(SHELL) USB3.4(SHELL) USB3.A1B12(GND) USB3.B1A12(GND) X2.2 X2.4
VBAT: C21.2 R14.2 U4.7(VIN) U5.1
VCC5V: C23.2 C24.2 C25.1 C28.2 C29.2 C30.1 CN2.1 D1.2(A) L3.2 R10.2 R12.2 R23.1 U6.1 U7.1(VIN) U7.3(EN) U8.1(VIN) U8.3(EN) U14.1 USB3.A4B9(VBUS) USB3.B4A9(VBUS)
CAM3V3: C31.2 C32.2 FPC1.17 FPC1.18 U8.5(VOUT)
MCU3V3: C6.2 C7.2 C8.2 C9.2 C10.2 C15.2 C16.2 D2.1(K) D3.1(K) D4.1 H4.1 L2.1 R5.2 R6.1 R8.1 R9.1 R28.1 SW1.2 U1.11(VDD_5) U1.28(VDD_4) U1.50(VIO_1) U1.75(VDD_2) U1.100(VIO_3) U2.5(VOUT)
OSC8IN: C4.2 U1.12(OSC_IN) X2.3
OSC8OUT: C3.1 U1.13(OSC_OUT) X2.1
OSC32IN: C2.2 U1.8(PC14/OSC32IN) X1.2
OSC32OUT: C1.2 U1.9(PC15/OSC32OUT) X1.1
PA0: R33.1 U1.23(PA0/WKUP/ADC0)
PA1: R34.1 U1.24(PA1/ADC1)
PA2: R32.1 U1.25(PA2/ADC2)
PA3: R31.1 U1.26(PA3/ADC3)
PA4: FPC1.5 U1.29(PA4/ADC4/DAC0)
PA5: FPC1.6 U1.30(PA5/ADC5/DAC1)
PA6: FPC1.1 U1.31(PA6/ADC6)
PA7: CN2.3 U1.32(PA7/ADC7)
PA8: C35.2 R20.2 SW3.A U1.67(PA8)
PA9: FPC1.8 U1.68(PA9)
PA10: FPC1.9 U1.69(PA10)
PB0: LED6.1(C) U1.35(PB0/ADC8)
PB1: C33.2 R14.1 R15.2 U1.36(PB1/ADC9)
PB2: R1.2 R27.1 U1.37(PB2/BOOT1)
PB3: U1.89(PB3) U3.2(SCL/SPC)
PB4: U1.90(PB4) U3.4(SA0/SDO)
PB5: U1.91(PB5) U3.3(SDA/SDI)
PB6: FPC1.13 U1.92(PB6/USB2DM)
PB7: H2.10 U1.93(PB7/USB2DP)
PB8: FPC1.14 U1.95(PB8)
PB9: FPC1.15 U1.96(PB9)
PB10: R29.1 U1.47(PB10)
PB11: R30.1 U1.48(PB11)
PB12: C36.2 R22.1 SW3.D U1.51(PB12)
PB13: CN2.8 H2.6 U1.52(PB13)
PB14: CN2.6 U1.53(PB14)
PB15: CN2.7 H2.8 U1.54(PB15)
PC0: CN2.5 U1.15(PC0/ADC10)
PC1: CN2.4 U1.16(PC1/ADC11)
PC4: LED5.1(C) U1.33(PC4/ADC14)
PC5: LED2.1(C) U1.34(PC5/ADC15)
PC6: U1.63(PC6/RXP) U13.1
PC7: U1.64(PC7/RXN) U13.3
PC8: FPC1.10 U1.65(PC8/TXP)
PC9: FPC1.11 U1.66(PC9/TXN)
PC10: U1.78(PC10) U3.5(CS)
PC11: FPC1.12 U1.79(PC11)
PC12: FPC1.4 U1.80(PC12)
PC13: R24.1 R25.1 U1.7(PC13/TAMPER-RTC)
PD0: H2.16 U1.81(PD0)
PD2: FPC1.3 U1.83(PD2)
PD4: H2.14 U1.85(PD4)
PD5: U1.86(PD5) U15.4
PD6: U1.87(PD6) U15.3
PD7: H2.12 U1.88(PD7)
PD8: C34.2 R21.2 SW3.B U1.55(PD8)
PD9: H3.4 U1.56(PD9)
PD11: H3.3 U1.58(PD11)
PD12: R35.1 U1.59(PD12)
PD13: R36.1 U1.60(PD13)
PD14: R37.1 U1.61(PD14)
PD15: R38.1 U1.62(PD15)
PE0: H2.1 U1.97(PE0)
PE1: H2.3 U1.98(PE1)
PE2: H2.5 U1.1(PE2)
PE3: H2.7 U1.2(PE3)
PE4: H2.9 U1.3(PE4)
PE5: H2.11 U1.4(PE5)
PE6: H2.13 U1.5(PE6)
PE7: H2.15 U1.38(PE7)
PE10: U1.41(PE10) U15.5
PE14: U1.45(PE14) U14.4
PE15: U1.46(PE15) U14.3
RST: C5.2 H4.10 R5.1 SW2.2 U1.14(NRST)
SWCLK: H4.4 U1.76(PA14/SWCLK)
SWDIO: H4.2 U1.72(PA13/SWDIO)
USB_N: U1.70(PA11/USB1DM) USB3.A8(SBU1) USB3.B6(DP2)
USB_P: U1.71(PA12/USB1DP) USB3.A7(DN1) USB3.B5(CC2)
$1N1167: R2.1 R39.2 U1.94(BOOT0)
$1N1260: R2.2 SW1.1
$1N1594: R3.2 U1.20(VREF-)
$1N1670: R4.2 U1.21(VREF+)
$1N2218: R6.2 U1.6(VBAT)
$1N2483: C11.1 L1.2 R3.1 U1.19(VSSA)
$1N2491: C11.2 L2.2 R4.1 U1.22(VDDA)
$1N3131: D1.1(C) F1.2
$1N3174: C12.2 C13.2 C14.1 F1.1 U2.1(VIN) U2.3(EN)
$1N3676: LED2.2(A) R8.2
$1N4247: C22.1 U4.1(BOOT)
$1N4481: LED4.2(A) R12.1
$1N4522: R10.1 R11.2 U4.4(VSENSE)
$1N4615: C22.2 D5.2(K) L3.1 U4.8(PH)
$1N6536: R18.1 USB3.A5(CC1)
$1N6588: R19.1 USB3.B7(DN2)
$1N10758: LED5.2(A) R28.2
$1N10833: LED6.2(A) R9.2
$1N13238: H4.7 R29.2
$1N13240: H4.9 R30.2
$2N274: C19.1 U3.14(REGOUT)
$2N2403: BUZZER1.1(+) R23.2
$2N2455: BUZZER1.2(-) Q2.3
$2N2507: Q2.1 R24.2
$2N2796: CN1.3 R26.2 R27.2
$2N5692: R38.2 U10.4
$2N5694: R37.2 U10.3
$2N5696: R36.2 U10.2
$2N5698: R35.2 U10.1
$2N5700: R31.2 U10.7
$2N5702: R32.2 U10.8
$2N5704: R33.2 U10.10
$2N5706: R34.2 U10.9

Not connected (* = marked no-connect by the designer): H3 5* 6*; H4 6* 8*; U1 17(PC2/ADC12)* 18(PC3/ADC13)* 39(PE8)* 40(PE9)* 42(PE11)* 43(PE12)* 44(PE13)* 57(PD10)* 73(NC)* 77(PA15)* 82(PD1)* 84(PD3)*; U2 4(NC)*; U3 7(RESV)*; U4 2(NC)* 3(NC)* 5(ENA)*; U7 4(NC)*; U8 4(NC)*; USB3 A6(DP1)* B8(SBU2)*

## Notes on the sheets
sheet 2
- IMU
